# EAGLE board BMS (EAGLE 7.5.0), part 1 of 2 (continued)
## Placement (x,y rotation side) (continued)
R195  16  [RR02J16RTB]  6.88,34.42 0 top
R196  16  [RR02J16RTB]  3.45,30.23 180 top
R197  16  [RR02J16RTB]  7.14,43.43 0 top
R198  16  [RR02J16RTB]  3.07,38.61 180 top
R199  16  [RR02J16RTB]  3.33,47.62 180 top
R200  16  [RR02J16RTB]  6.38,52.71 0 top
R201  16  [RR02J16RTB]  6.25,61.47 0 top
R202  16  [RR02J16RTB]  2.69,57.02 180 top
R203  16  [RR02J16RTB]  5.87,69.09 0 top
R204  16  [RR02J16RTB]  2.57,65.41 180 top
R205  16  [RR02J16RTB]  5.99,76.96 0 top
R206  16  [RR02J16RTB]  2.18,73.02 180 top
R207  16  [RR02J16RTB]  6.12,84.84 0 top
R208  16  [RR02J16RTB]  2.31,80.64 180 top
R209  16  [RR02J16RTB]  6.12,92.15 0 top
R210  16  [RR02J16RTB]  2.57,88.57 180 top
R211  16  [RR02J16RTB]  2.44,97.61 180 top
R212  16  [RR02J16RTB]  6.25,101.14 0 top
R213  1K  [0603]  46.61,41.2 90 top
R214  10K  [MNR14]  44.38,31.27 90 top
R215  100K  [0603]  46.61,37.01 270 top
R216  1.2K  [0603]  52.4,58.81 180 top
R217  787  [0805]  47.25,57.06 90 top
R218  10K-NTC  [NTC-NXRT15XH103FA5B]  38,10.1 90 top
R219  10K-NTC  [NTC-NXRT15XH103FA5B]  27.77,36.08 90 top
R220  10K-NTC  [NTC-NXRT15XH103FA5B]  34.96,65.6 0 top
R221  10K-NTC  [NTC-NXRT15XH103FA5B]  27.17,91.56 270 top
SJ1  [PAD-JUMPER-3-NO_YES_SILK]  142.38,78.16 180 top
SJ2  [PAD-JUMPER-3-NO_YES_SILK]  142.38,76.13 180 top
SJ3  [PAD-JUMPER-3-NO_YES_SILK]  142.38,74.09 180 top
SJ4  [PAD-JUMPER-3-NO_YES_SILK]  142.38,72.06 180 top
SJ5  [PAD-JUMPER-2-NO_YES_SILK]  139.13,57.64 180 bottom
SJ6  [PAD-JUMPER-3-NO_YES_SILK]  97.75,72.46 180 top
SJ7  [PAD-JUMPER-3-NO_YES_SILK]  97.67,75.16 180 top
SJ8  [PAD-JUMPER-3-NO_YES_SILK]  97.7,77.8 180 top
SJ9  [PAD-JUMPER-3-NO_YES_SILK]  97.7,80.45 180 top
SJ10  [PAD-JUMPER-2-NO_YES_SILK]  102.55,55.36 90 top
SJ11  [PAD-JUMPER-3-NO_YES_SILK]  47.17,75.37 0 top
SJ12  [PAD-JUMPER-3-NO_YES_SILK]  47.11,78.09 0 top
SJ13  [PAD-JUMPER-3-NO_YES_SILK]  47.04,81.16 0 top
SJ14  [PAD-JUMPER-3-NO_YES_SILK]  46.98,84.24 0 top
SJ15  [PAD-JUMPER-2-NO_YES_SILK]  50.61,56.06 90 top
TX1  PE-68386NLT  [PE-68386NLT]  147.47,92.84 0 top
TX2  PE-68386NLT  [PE-68386NLT]  147.47,83.95 0 top
TX3  PE-68386NLT  [PE-68386NLT]  147.47,101.73 0 top
U1  LTC6804-2  [SSOP-48]  140.72,55.43 270 top
U2  LTC6804-2  [SSOP-48]  95.95,55.34 270 top
U3  LTC6804-2  [SSOP-48]  40.03,55.12 270 top
U$1  POGOPIN  [POGOPIN]  130.5,6.59 0 top
U$2  POGOPIN  [POGOPIN]  127.1,11.45 0 top
U$3  POGOPIN  [POGOPIN]  116.28,20.21 0 top
U$4  POGOPIN  [POGOPIN]  127.11,28.93 0 top
U$5  POGOPIN  [POGOPIN]  116.3,37.69 0 top
U$6  POGOPIN  [POGOPIN]  127.12,46.43 0 top
U$7  POGOPIN  [POGOPIN]  116.28,55.19 0 top
U$8  POGOPIN  [POGOPIN]  127.12,63.93 0 top
U$9  POGOPIN  [POGOPIN]  116.28,72.69 0 top
U$10  POGOPIN  [POGOPIN]  127.13,81.43 0 top
U$11  POGOPIN  [POGOPIN]  116.29,90.19 0 top
U$12  POGOPIN  [POGOPIN]  127.12,98.94 0 top
U$13  POGOPIN  [POGOPIN]  133.89,106.78 0 top
U$14  POGOPIN  [POGOPIN]  37.85,5.05 0 top
U$15  POGOPIN  [POGOPIN]  36.33,11.42 0 top
U$16  POGOPIN  [POGOPIN]  25.48,20.19 0 top
U$17  POGOPIN  [POGOPIN]  36.33,28.92 0 top
U$18  POGOPIN  [POGOPIN]  25.46,37.7 0 top
U$19  POGOPIN  [POGOPIN]  36.31,46.44 0 top
U$20  POGOPIN  [POGOPIN]  25.47,55.2 0 top
U$21  POGOPIN  [POGOPIN]  36.32,63.94 0 top
U$22  POGOPIN  [POGOPIN]  25.48,72.7 0 top
U$23  POGOPIN  [POGOPIN]  36.32,81.44 0 top
U$24  POGOPIN  [POGOPIN]  25.48,90.2 0 top
U$25  POGOPIN  [POGOPIN]  36.3,98.94 0 top
U$26  POGOPIN  [POGOPIN]  37.75,106.2 0 top
U$27  LOGO16-2-L  [2016-2-LOGO-L]  51.59,10.59 90 top
U$40  POGOPIN  [POGOPIN]  84.79,4.96 0 top
U$41  POGOPIN  [POGOPIN]  81.7,11.44 0 top
U$42  POGOPIN  [POGOPIN]  70.9,20.2 0 top
U$43  POGOPIN  [POGOPIN]  81.73,28.94 0 top
U$44  POGOPIN  [POGOPIN]  70.88,37.7 0 top
U$45  POGOPIN  [POGOPIN]  81.72,46.45 0 top
U$46  POGOPIN  [POGOPIN]  70.87,55.19 0 top
U$47  POGOPIN  [POGOPIN]  81.7,63.93 0 top
U$48  POGOPIN  [POGOPIN]  70.88,72.72 0 top
U$49  POGOPIN  [POGOPIN]  81.73,81.43 0 top
U$50  POGOPIN  [POGOPIN]  70.88,90.19 0 top
U$51  POGOPIN  [POGOPIN]  81.71,98.95 0 top
U$52  POGOPIN  [POGOPIN]  82.95,106.02 0 top

## Tracks (layer width: path | path; a pad name or v marks a point on that pad's centre or on a via)
A0  (via drill 0.5)
  Top 0.178: U2.45 95.71,59.59 95.25,60.05 v95.25,62.87 | v95.1,80.49 95.1,81.38 95.63,81.91 97.41,81.91 97.59,81.74 97.59,80.57 SJ9.2
  Bottom 0.178: v95.25,62.87 95.25,68.2 94.56,68.96 92.38,68.96 91.77,69.72 91.77,80.03 92.61,80.49 v95.1,80.49
A1  (via drill 0.5)
  Top 0.178: U2.46 96.84,60.09 96.52,60.4 v96.52,62.89 | v95.1,77.83 95.1,78.71 95.45,79.07 97.59,79.07 97.76,78.89 97.76,77.87 SJ8.2
  Bottom 0.178: v96.52,62.89 96.52,67.69 94.67,69.62 92.56,69.62 92.2,69.98 92.2,77.47 92.56,77.83 v95.1,77.83
A2  (via drill 0.5)
  Top 0.178: U2.47 97.94,60.59 97.76,60.76 v97.76,62.89 | v95.1,75.16 95.1,76.05 95.45,76.4 97.59,76.4 97.76,76.22 97.76,75.24 SJ7.2
  Bottom 0.178: v97.76,62.89 97.76,66.98 94.84,70.05 93.12,70.05 92.79,70.38 92.79,74.8 93.14,75.16 v95.1,75.16
A3  (via drill 0.5)
  Top 0.178: U2.48 99.37,62.53 v99.01,62.89 | v95.1,72.49 95.1,73.38 95.45,73.74 97.41,73.74 97.76,73.38 97.76,72.47 SJ6.2
  Bottom 0.178: v99.01,62.89 99.01,66.42 95.17,70.48 93.65,70.48 93.45,70.69 93.45,72.31 93.62,72.49 v95.1,72.49
A4
  Top 0.178: SJ4.2 142.38,71.18 143.18,70.38 143.18,63.3 141.81,61.93 141.81,60.33 142.42,59.72 143.87,59.72 143.94,59.64 144.1,59.64 U1.45
A5
  Top 0.178: SJ3.2 142.38,74.92 142.57,75.11 144.12,75.11 144.27,74.95 144.27,63.63 142.34,61.7 142.34,60.63 142.8,60.17 U1.46
A6
  Top 0.178: SJ2.2 142.38,76.92 142.57,77.11 144.48,77.11 144.68,76.89 144.68,63.37 144.37,63.07 144.35,63.07 142.82,61.54 142.82,60.91 143.03,60.71 144.12,60.71 U1.47
A7
  Top 0.178: U1.48 144.14,62.07 145.08,63.02 145.08,79.05 144.35,79.78 142.75,79.78 142.39,79.43 142.39,78.21 SJ1.2
A8  (via drill 0.5)
  Top 0.178: U3.45 50.33,59.37 52.15,61.06 55.35,61.06 55.98,61.72 55.98,66.09 v55.63,66.45 | v51.18,84.23 51.18,85.83 50.65,86.36 47.27,86.36 46.91,86 46.91,84.3 SJ14.2
  Bottom 0.178: v51.18,84.23 55.35,84.23 55.58,84 55.58,66.5 v55.63,66.45
A9  (via drill 0.5)
  Top 0.178: U3.46 50.29,59.87 51.89,61.44 53.37,61.44 53.72,61.82 53.82,65.02 53.29,65.56 52.6,65.56 52.43,65.73 v52.43,66.45 | v51.18,81.2 51.18,82.27 50.83,82.63 47.27,82.63 46.91,82.27 46.91,81.29 SJ13.2
  Bottom 0.178: v52.43,66.45 52.43,67.16 52.78,67.51 52.78,75.36 51.89,76.25 51.71,76.4 51,77.11 51,81.03 v51.18,81.2
A10  (via drill 0.5)
  Top 0.178: U3.47 49.9,60.37 51.16,61.67 51.16,67 51.54,67.33 53.85,67.33 54.03,67.16 v54.03,66.45 | v52.07,78.16 52.07,79.07 51.54,79.6 47.63,79.6 47.09,79.07 47.09,78.1 SJ12.2
  Bottom 0.178: v54.03,66.45 54.2,66.45 54.18,69.62 54.2,77.49 53.49,78.21 52.1,78.18 v52.07,78.16
A11
  Top 0.178: U3.48 49.68,60.87 50.77,61.88 50.77,71.65 50.11,72.31 47.8,72.31 47.27,72.85 47.27,75.27 SJ11.2
C0  (via drill 0.5)
  Top 0.178: v82.3,17.91 84.01,17.91 R110.2 | U2.26 v101.85,50.09
  Bottom 0.178: v82.3,17.91 82.3,18.26 81.94,18.62 79.45,18.62 79.1,18.97 79.1,23.06 78.96,23.2 C57.1 77.95,23.28 C55.2 84.06,25.39 84.61,24.84 84.61,23.06 85.32,22.35 89.94,22.35 90.3,22.71 90.3,48.57 90.75,49.02 101.68,49.02 102.03,49.38 102.03,49.91 v101.85,50.09
C1  (via drill 0.5)
  Top 0.178: R107.2 v85.5,23.77 87.99,23.77 88.34,24.13 88.34,49.38 88.55,49.59 U2.24
  Bottom 0.178: C56.1 77.85,26.99 C55.1 77.95,30.35 | 77.95,30.35 77.95,30.63 78.56,31.24 78.56,32.32 C53.2 | v85.5,23.77 85.5,30.17 85.14,30.53 78.13,30.53 77.95,30.35
C2  (via drill 0.5)
  Top 0.178: R104.2 v85.14,31.6 86.97,31.6 87.5,32.13 87.5,50.08 88.01,50.59 U2.22
  Bottom 0.178: C51.2 C53.1 | C54.1 78.41,34.18 C53.1 | C53.1 84.6,34.1 85.14,33.55 v85.14,31.6
C3  (via drill 0.5)
  Top 0.178: R101.2 v85.14,37.29 86.21,37.29 86.64,37.72 86.64,50.9 87.33,51.59 U2.20
  Bottom 0.178: C49.2 C51.1 | C52.1 78.41,38.09 C51.1 | C51.1 80,38.01 80.34,38.35 84.79,38.35 85.14,38 v85.14,37.29
C4  (via drill 0.5)
  Top 0.178: U2.18 86.16,52.59 85.75,52.17 85.75,48.67 85.32,48.23 v85.32,43.16 83.55,43.16 R98.2
  Bottom 0.178: C47.2 C49.1 | C50.1 78.41,42.36 C49.1 | C49.1 79.82,42.28 80.16,42.62 80.16,44.4 80.52,44.76 85.14,44.76 85.32,44.58 v85.32,43.16
C5  (via drill 0.5)
  Top 0.178: R92.2 82.71,51.16 v84.43,51.16 84.43,53.29 84.73,53.59 U2.16
  Bottom 0.178: C48.1 78.41,46.16 C47.1 C43.2 79.62,48.66 79.81,48.84 79.81,51.87 79.98,52.05 84.25,52.05 84.43,51.87 v84.43,51.16
C6  (via drill 0.5)
  Top 0.178: U2.14 92.48,54.53 84.28,54.53 83.95,54.94 v83.95,56.31 83.92,56.34 R95.2
  Bottom 0.178: C44.1 78.41,50.43 C43.1 78.31,50.53 C45.2 78.4,58.62 79.27,58.62 79.63,58.27 79.63,57.91 79.98,57.56 83.67,57.56 83.95,57.28 v83.95,56.31
C7  (via drill 0.5)
  Top 0.178: U2.12 85.87,55.59 85.5,55.96 85.5,60.94 85.14,61.29 v84.25,61.29 82.49,61.29 82.49,60.63 R89.2
  Bottom 0.178: C41.2 C45.1 | C46.1 78.28,60.39 C45.1 | C45.1 79.44,60.41 79.98,59.87 83.9,59.87 84.25,60.22 v84.25,61.29
C8  (via drill 0.5)
  Top 0.178: R86.2 v84.25,70.54 85.9,70.54 86.36,70 86.36,57 86.7,56.59 U2.10
  Bottom 0.178: C42.1 78.23,64.3 C41.1 C39.2 79.21,66.33 79.45,66.09 81.23,66.09 81.41,65.91 82.22,65.91 82.83,65.23 83.9,65.23 84.43,65.91 84.43,70.36 v84.25,70.54
C9  (via drill 0.5)
  Top 0.178: R83.2 84.23,75.84 v84.25,75.87 | v83.19,66.09 83.19,63.6 83.54,63.25 v84.07,63.25 | v87.63,58.09 88.16,57.56 92.5,57.56 U2.8
  Bottom 0.178: C40.1 78.13,68.21 C39.1 | C39.1 78.21,68.13 78.21,69.11 77.6,69.72 C37.2 77.81,76.58 78.92,76.58 79.45,77.11 83.9,77.11 84.25,76.76 v84.25,75.87 | C39.1 82.84,68.03 83.19,67.69 v83.19,66.09 | v84.07,63.25 86.92,63.25 87.45,62.71 87.45,58.27 v87.63,58.09
C10  (via drill 0.5)
  Top 0.178: R77.2 83.07,85.29 v84.79,85.29 87.05,85.29 87.66,84.68 87.66,60.22 89.07,58.59 U2.6
  Bottom 0.178: C38.1 77.49,78.6 C37.1 C34.2 80.33,80.86 81.05,80.14 84.61,80.14 85.14,80.67 85.14,84.94 v84.79,85.29
C11  (via drill 0.5)
  Top 0.178: R78.2 v84.79,90.63 87.63,90.63 88.49,89.84 88.49,60.5 89.34,59.59 U2.4
  Bottom 0.178: C36.1 77.49,82.66 C34.1 C33.2 83.17,84.93 84.79,86.54 v84.79,90.63
C12  (via drill 0.5)
  Top 0.178: v84.96,95.61 R76.2 | U2.2 89.76,60.59 89.41,60.94 v89.41,93.47
  Bottom 0.178: 74.61,86.89 C35.1 77.24,86.98 C33.1 | C33.1 77.6,96.77 78.21,97.38 84.43,97.38 84.96,96.85 v84.96,95.61 | C33.1 83.1,86.63 83.72,87.25 83.72,91.16 84.25,91.69 89.05,91.69 89.41,92.05 v89.41,93.47
C13  (via drill 0.5)
  Top 0.178: v126.57,89.56 129.95,89.56 130.3,89.92 130.3,91.15 R4.2 130.29,91.16 135.79,91.16 136.68,90.27 136.68,62.23 136.25,61.8 136.25,60.78 136.35,60.68 U1.2
  Bottom 0.178: C5.1 123.96,88.79 124.26,88.49 | 124.26,88.49 124.26,86.52 C3.1 | 124.26,88.49 126.21,88.49 126.57,88.85 v126.57,89.56
C14  (via drill 0.5)
  Top 0.178: R6.2 130.09,86 v131.9,86 134.21,86 135.43,84.94 135.43,60.2 135.95,59.68 U1.4
  Bottom 0.178: C6.1 124.36,84.72 C3.2 | C3.2 124.38,79.84 C4.1 | C3.2 131.48,84.7 131.9,85.11 v131.9,86
C15  (via drill 0.5)
  Top 0.178: R11.2 129.91,74.09 v131.72,74.09 132.79,74.09 133.71,73.33 133.63,58.22 134.17,57.68 U1.8
  Bottom 0.178: C10.1 124.71,74.1 C7.2 | C7.2 124.74,71.26 C9.1 | C7.2 126.22,74.08 126.57,73.74 126.57,73.02 126.92,72.67 131.55,72.67 131.72,72.85 v131.72,74.09
C16  (via drill 0.5)
  Top 0.178: U1.12 132.1,55.68 131.83,56.03 131.83,61.37 131.37,61.82 | v126.92,60.94 127.46,60.4 131.01,60.4 131.37,60.76 131.37,61.82 | 131.37,61.82 131.37,64.17 R17.2
  Bottom 0.178: C16.1 122.15,56.12 C15.1 C11.2 125.49,58.45 126.57,58.45 126.92,58.8 v126.92,60.94
C17  (via drill 0.5)
  Top 0.178: U1.14 131.42,54.68 130.96,55.14 130.96,56.29 130.76,56.49 130.06,56.49 R23.2 129.95,56.43 129.95,55.42 129.59,55.07 v127.1,55.07
  Bottom 0.178: C14.1 122.17,52.41 C13.1 C15.2 126.45,54.42 v127.1,55.07
C18  (via drill 0.5)
  Top 0.178: U1.16 131.46,53.68 131.01,53.32 131.01,52.22 130.84,52.05 130.3,52.05 130.12,51.87 129.81,51.87 R20.2 130.99,51.38 v131.17,51.21
  Bottom 0.178: C18.1 124.36,48.6 C17.1 124.79,48.27 124.79,49.38 125.45,50.04 C13.2 126.66,50.71 127.1,50.27 127.1,49.73 127.28,49.55 130.91,49.55 131.17,49.81 v131.17,51.21
C19  (via drill 0.5)
  Top 0.178: R29.2 130.09,38.53 v131.72,38.53 132.87,38.53 133.27,38.94 133.27,51.33 133.62,51.68 U1.20
  Bottom 0.178: C19.2 C23.1 | C24.1 125.19,39.77 C23.1 | C23.1 131.46,39.51 131.72,39.24 v131.72,38.53
C20  (via drill 0.5)
  Top 0.178: R32.2 130.09,32.84 v131.72,32.84 133.86,32.84 134.29,33.27 134.29,50.37 134.6,50.68 U1.22
  Bottom 0.178: C25.1 C23.2 | C26.1 125.37,35.8 C25.1 | C25.1 126.53,35.72 126.92,35.33 126.92,34.44 127.28,34.09 131.37,34.09 131.72,33.73 v131.72,32.84
C21  (via drill 0.5)
  Top 0.178: v130.66,28.4 130.66,26.91 R35.2 134.21,26.8 135.15,27.51 135.15,49.38 135.46,49.68 U1.24
  Bottom 0.178: C27.1 125.39,25.02 123.01,25.02 122.25,25.78 C28.1 122.29,32.13 125.15,32.13 125.45,32.44 C25.2 125.45,27.74 126.03,27.15 127.46,27.15 128.52,28.22 130.48,28.22 v130.66,28.4
C22  (via drill 0.5)
  Top 0.178: R5.2 129.96,79.07 v131.55,79.07 133.68,79.07 134.57,78.18 134.57,59.05 134.94,58.68 U1.6
  Bottom 0.178: C8.1 124.71,77.81 C4.2 | C4.2 C7.1 | C4.2 131.33,77.79 131.55,78 v131.55,79.07
C23  (via drill 0.5)
  Top 0.178: U1.26 145.15,50.18 145.24,50.09 145.24,49.02 143.28,47.07 v142.21,47.07 | v132.61,20.75 130.64,20.75 R38.2
  Bottom 0.178: C27.2 C29.1 131.99,21.37 v132.61,20.75 133.32,21.46 133.32,23.06 134.92,24.66 138.3,24.66 140.61,26.97 140.61,46.71 140.97,47.07 v142.21,47.07
C24  (via drill 0.5)
  Top 0.178: v127.28,42.8 129.77,42.8 129.95,42.98 129.95,44.23 R26.2 130.14,44.22 132.05,44.22 132.41,44.65 132.41,52.27 132.89,52.68 U1.18
  Bottom 0.178: C22.1 124.61,46.39 C17.2 124.74,45.34 125.32,44.76 125.32,43.55 C19.1 126.66,43.42 v127.28,42.8
C25  (via drill 0.5)
  Top 0.178: R14.2 129.86,69.29 131.55,69.29 131.72,69.11 v131.72,68.4 132.77,67.51 132.77,57.02 133.11,56.68 U1.10
  Bottom 0.178: C12.1 124.51,69.33 C9.2 | C9.2 124.59,62.38 125.32,61.65 125.32,60.31 C11.1 | C9.2 125.92,69.41 126.39,68.94 126.39,68.4 126.75,68.05 131.37,68.05 v131.72,68.4
C26  (via drill 0.5)
  Top 0.178: v21.13,94.72 21.23,94.82 R151.2 23.8,94.7 23.8,94 23.98,93.83 30.89,93.83 31.6,93.12 31.52,60.94 32.09,60.37 U3.2
  Bottom 0.178: C67.1 21.23,85.25 C65.1 21.13,85.36 v21.13,94.72
C27  (via drill 0.5)
  Top 0.178: R153.2 25.63,85.47 v27.36,85.47 30.25,85.47 30.68,85.11 30.68,60.22 31.39,59.37 U3.4
  Bottom 0.178: C68.1 21.29,80.63 C66.1 21.36,83.43 | 21.36,83.43 C65.2 | 21.36,83.43 22.29,83.43 22.73,83.87 22.73,84.23 23.09,84.58 27,84.58 27.36,84.94 v27.36,85.47
C28  (via drill 0.5)
  Top 0.178: R158.2 25.49,75.34 v27.18,75.34 28.19,75.34 28.96,74.57 28.96,58.65 30.24,57.37 U3.8
  Bottom 0.178: C72.1 21.23,67.17 C71.1 21.49,67.3 C69.2 26.81,74.61 27.18,74.98 v27.18,75.34
C29  (via drill 0.5)
  Top 0.178: v26.77,59.87 25.46,59.87 R164.2 | U3.12 27.74,55.37 27.2,55.91 27.2,59.44 v26.77,59.87 | 27.18,59.69 v26.77,59.87
  Bottom 0.178: C78.1 C77.1 21.23,58.41 C73.2 26.61,61.28 26.77,61.04 v26.77,59.87
C30  (via drill 0.5)
  Top 0.178: R170.2 v25.76,52.4 26.34,52.4 26.52,52.65 26.52,54 26.81,54.37 U3.14
  Bottom 0.178: C76.1 C75.1 | C75.1 C77.2 | C75.1 22.19,49.9 22.38,50.09 22.38,50.98 22.73,51.33 25.58,51.33 25.76,51.51 v25.76,52.4
C31  (via drill 0.5)
  Top 0.178: U3.16 36.58,53.34 27.61,53.34 27.38,53.11 27.38,49.2 27.2,49.02 v26.82,49.02 26.82,48.49 26.64,48.31 25.46,48.31 R167.2
  Bottom 0.178: C80.1 C79.1 C75.2 22.09,48.2 22.56,48.67 22.56,49.02 22.91,49.38 26.47,49.38 v26.82,49.02
C32  (via drill 0.5)
  Top 0.178: U3.20 29.57,51.37 29.18,50.9 29.18,33.83 28.6,33.55 v27.89,33.55 27.89,34.62 27.71,34.8 R176.2
  Bottom 0.178: C84.1 C83.1 | C83.1 20.98,39.18 C81.2 | C83.1 22.16,32.62 22.56,33.02 22.56,33.55 22.73,33.73 27.71,33.73 v27.89,33.55
C33  (via drill 0.5)
  Top 0.178: R179.2 25.54,30 v27.36,30 29.54,30 30.05,30.28 30.05,49.84 30.58,50.37 U3.22
  Bottom 0.178: C86.1 C85.1 C83.2 27.14,30.92 27.36,30.71 v27.36,30
C34  (via drill 0.5)
  Top 0.178: 25.64,24.89 R182.2 v27.18,25.02 30.18,25.02 30.94,25.48 30.94,48.77 31.46,49.37 U3.24
  Bottom 0.178: C88.1 C87.1 18.62,24.82 19,25.2 19.53,25.2 19.71,25.38 19.71,25.91 19.89,26.09 21.09,26.09 C85.2 26.81,26.1 27.18,25.73 v27.18,25.02
C35  (via drill 0.5)
  Top 0.178: R152.2 25.46,80.85 v27.18,80.85 29.31,80.85 29.82,80.34 29.82,59.72 30.94,58.37 U3.6
  Bottom 0.178: C70.1 C69.1 C66.2 22.34,78.85 22.91,79.43 26.82,79.43 27.18,79.78 v27.18,80.85
C36  (via drill 0.5)
  Top 0.178: R185.2 33.38,19.04 C89.1 | R185.2 28.72,19.04 v28.6,19.15 | U3.26 44.29,49.87 44.78,49.38 44.78,49.02 44.42,48.67 38.56,48.67 38.02,48.13 32.16,48.13 31.85,47.83 31.85,19.77 R185.2
  Bottom 0.178: v28.6,19.15 26.47,19.15 26.11,18.8 23.98,18.8 23.62,19.15 23.62,21.29 23.27,21.64 18.76,21.64 C87.2
C37  (via drill 0.5)
  Top 0.178: R173.2 25.59,42.98 v27.36,42.98 27.97,42.98 28.32,43.33 28.32,52.05 28.64,52.37 U3.18
  Bottom 0.178: C82.1 C81.1 21.11,41.26 C79.2 26.91,44.13 27.36,43.69 v27.36,42.98
C38  (via drill 0.5)
  Top 0.178: R161.2 25.24,67.33 v26.82,67.33 27.81,67.33 28.09,67.06 28.09,56.64 28.37,56.37 U3.10
  Bottom 0.178: C74.1 21.11,62.85 C73.1 21.36,63.11 C71.2 26.56,65.47 26.82,65.73 v26.82,67.33
DRIVE  (via drill 0.5)
  Top 0.178: U2.38 97.81,56.09 v97.41,56.49 | v104.14,63.27 102.33,63.27 1.B
  Bottom 0.178: v97.41,56.49 97.41,57.02 97.59,57.2 104.34,57.2 104.7,57.56 104.7,63.25 v104.14,63.27
DRIVE1  (via drill 0.3)
  Top 0.178: U1.38 141.99,56.18 140.89,57.28 v140.67,57.28
  Bottom 0.178: v140.67,57.28 140.67,65.66 141.73,66.73 2.B
DRIVE2
  Top 0.178: U3.38 40.78,55.87 40.34,56.31 40.34,59.16 40.51,59.33 40.69,59.33 40.87,59.51 40.87,60.4 42.11,61.65 42.65,61.65 43.54,62.54 46.25,62.54 46.94,62.92 46.94,66.61 3.B 46.89,66.86
GND  (via drill 0.5)
  Top 0.178: U3.30 v46.56,51.87 | C90.2 52.33,54.04 52.4,53.98
  other vias: 19.89,37.29 43.84,43.31 45.95,64.52 50.44,73.79 52.4,62.33 39.55,50.44 34.26,46.89 45.64,57.45 36.91,62.13 41.48,54.71 35.48,71.37 41.78,71.07 51.05,46.36 49.94,70.74
  pour Bottom: 0.15,0.13 0.15,111.38 53.14,112.37 53.29,-0.71
  pour Top (rank 6): 0.15,0.13 53.29,-0.51 53.06,111.35 0.15,111.38
GNDA  (via drill 0.5)
  Top 0.178: R144.P$1 80.21,62.65 78.94,61.47 74.83,61.47 v73.94,62.36 | U2.31 v97.24,52.59 v97.23,52.58
  other vias: 99.72,42.04 96.52,55.55 104.34,68.02 96.67,70.89 93.9,62.81
  pour Bottom: 59.84,114.43 105.56,114.43 105.56,-3.68 59.84,-3.68
  pour Top: 59.84,111.89 105.56,111.89 105.56,-1.14 59.84,-1.14
GNDI  (via drill 0.5, 0.6)
  Top 0.178: U1.31 142.11,52.68
  other vias: 133.76,18.41 127.41,18.41 136.8,44.58 126.64,94.36 138.3,73.56 141.15,52.76 134.92,89.92 139.6,79.68 132.13,93.5 141.99,33.6 133.25,87.3 138.18,27.25 128.45,61.39 130.48,63.17
  pour Top: 111.91,111.89 145.24,111.71 144.93,-1.14 111.91,-1.14
  pour Bottom: 111.91,114.43 144.93,114.43 144.93,-3.68 111.91,-3.68
GPIO1  (via drill 0.5)
  Top 0.178: U2.27 98.08,50.59 97.59,50.09 97.59,46 | 97.59,46 97.59,41.2 97.41,41.02 97.05,41.02 96.88,40.84 96.88,36.75 96.52,36.4 95.71,36.4 95.57,36.26 R139.1 | R143.P$2 68.93,94.51 69.49,95.07 75.72,95.07 76.07,95.43 76.07,100.05 77.14,101.12 81.23,101.12 81.58,101.47 81.58,102.72 82.12,103.25 83.36,103.25 83.72,102.89 83.72,102.36 84.07,102.01 90.12,102.01 90.83,101.3 90.83,89.2 90.65,88.67 90.65,69.65 91.19,69.11 104.88,69.11 105.59,68.58 105.59,46 v104.7,45.29 | v98.83,45.29 98.3,45.29 97.59,46
  Bottom 0.178: v104.7,45.29 v98.83,45.29
GPIO2  (via drill 0.5)
  Top 0.178: U2.28 96.81,51.09 96.52,50.8 v96.52,50.27 96.52,49.2 97.05,48.67 97.05,41.73 96.7,41.38 95.81,41.38 95.45,41.02 95.45,36.75 94.56,35.87 94.56,34.68 R139.2
  Bottom 0.178: R144.P$2 82.27,65.18 82.6,64.85 89.94,64.85 90.3,64.49 90.3,50.98 91.01,50.27 v96.52,50.27
GPIO3  (via drill 0.5)
  Top 0.178: R145.P$2 77.99,36.18 78.56,36.75 78.56,37.47 79.1,38 80.16,38 81.05,38.89 84.96,38.89 85.32,39.24 v85.32,39.6 | v89.41,39.6 93.32,39.6 | 93.32,39.6 93.5,39.6 94.03,39.07 94.03,34.71 R139.3 | 93.32,39.6 95.28,41.55 95.28,51.16 95.7,51.59 U2.29
  Bottom 0.178: v85.32,39.6 v89.41,39.6
GPIO4  (via drill 0.5)
  Top 0.178: U2.32 98.32,53.09 97.94,53.47 94.74,53.47 94.39,53.11 v94.39,42.09 | R139.4 93.07,35.98 92.89,36.17 92.3,36.17 v92.25,36.22
  Bottom 0.178: R146.P$2 83.46,12.75 90.65,12.75 91.36,13.46 91.36,35.69 91.9,36.22 v92.25,36.22 92.25,41.2 92.61,41.55 94.03,41.55 94.39,41.91 v94.39,42.09
GPIO5
  Top 0.178: R138.2 101.12,34.34 101.12,38.71 101.47,39.07 102.74,39.07 103.1,39.42 103.1,50.98 102.74,51.33 100.79,51.33 100.61,51.51 100.61,53.47 100.43,53.65 99.43,53.65 U2.33
GPIO6  (via drill 0.3)
  Top 0.178: R67.2 140.57,50.23 140.79,50.44 | 140.79,50.44 141.5,51.16 144.12,51.16 U1.28 | v140.61,50.8 140.79,50.44
  Bottom 0.178: v140.61,50.8 134.57,50.8 134.04,51.33 134.04,61.47 133.68,62 129.13,62 R72.P$2
GPIO7  (via drill 0.3, 0.5)
  Top 0.178: U1.27 142.21,50.68 | 142.21,50.68 141.92,50.68 141.33,50.09 141.33,38.13 R67.1 | R71.P$2 117.71,93.8 v117.68,93.83 | v142.21,50.16 142.21,50.68
  Bottom 0.178: v117.68,93.83 124.97,93.83 125.32,94.18 125.32,99.69 125.86,100.23 129.24,100.23 129.59,99.87 129.59,95.55 130.45,94.69 134.8,94.69 136.04,93.45 137.06,92.41 137.06,52.05 137.41,51.87 140.97,51.87 141.5,51.33 141.5,50.44 141.86,50.16 v142.21,50.16
GPIO8
  Top 0.178: R147.P$2 128.8,14.45 129.24,14.88 134.92,14.88 135.81,15.77 135.81,37.29 136.53,38 138.89,38 R67.4 139.07,38.03 139.07,39.95 139.08,52.28 140.41,53.62 141.63,53.62 142.07,53.18 U1.32
GPIO9  (via drill 0.5)
  Top 0.178: 139.75,38.06 R67.3 | U1.29 140.25,51.68 139.73,51.16 139.73,38.08 R67.3 | v137.39,36.37 137.59,36.4 138.3,37.11 139.55,37.11 139.73,37.29 139.73,37.98 R67.3
  Bottom 0.178: R73.P$2 120.54,39.4 121.21,38.66 130.28,38.66 130.84,38.18 130.84,37.47 131.19,37.11 136.7,37.11 v137.39,36.37
GPIO10
  Top 0.178: U1.33 145.1,53.68 145.31,53.47 145.31,50.62 145.62,50.32 145.62,48.74 143.08,46.2 143.08,30.61 142.06,29.59 142.06,29.09 R66.2
GPIO11  (via drill 0.5)
  Top 0.178: U3.28 45.6,50.87 46.74,49.73 46.74,47.42 46.56,47.24 41.05,47.24 40.51,46.71 40.51,31.6 40.34,31.42 40.16,31.42 39.8,31.06 v39.8,30.71 | v48.34,28.75 47.63,28.75 46.91,29.46 46.91,30.53 46.56,30.89 R214.2
  Bottom 0.178: v48.34,28.75 48.16,28.75 46.74,27.25 40.16,27.25 39.8,27.69 v39.8,30.71 39.8,38.18 39.4,38.58 R219.P$2
GPIO12  (via drill 0.5)
  Top 0.178: v38.2,30.71 38.2,31.6 38.56,31.95 39.62,31.95 39.98,32.31 39.98,47.24 40.51,47.78 45.67,47.78 46.02,48.13 46.02,49.55 45.14,50.44 43.53,50.44 U3.27 | v48.34,26.97 46.38,28.93 46.38,29.82 46.2,30 45.3,30 R214.1
  Bottom 0.178: v38.2,30.71 38.2,27.33 38.74,26.8 39.09,26.8 | 39.09,26.8 48.16,26.8 v48.34,26.97 | R218.P$2 38.76,12.6 39.09,12.93 39.09,26.8
GPIO13  (via drill 0.5)
  Top 0.178: v42.65,29.11 42.65,30 42.29,30.35 41.94,30.35 41.58,30.71 41.58,45.82 41.94,46.18 47.45,46.18 47.8,46.53 47.8,52.4 47.34,52.87 U3.32 43.39,52.93 41.76,52.93 41.4,53.29 v39.8,53.29 | v48.34,32.31 47.8,32.31 47.59,32.52 R214.4 | v34.65,89.2 v38.02,89.2
  Bottom 0.178: v42.65,29.11 42.65,28.57 43,28.22 45.85,28.22 46.38,28.75 46.38,31.95 46.74,32.31 v48.34,32.31 | R221.P$2 34.5,89.06 v34.65,89.2 | v38.02,89.2 38.02,69.65 38.38,69.29 39.27,69.29 39.62,68.94 39.62,53.47 v39.8,53.29
GPIO14  (via drill 0.5)
  Top 0.178: v41.05,29.11 41.05,46.36 41.4,46.71 47.09,46.71 47.27,46.89 47.27,49.91 45.81,51.37 U3.29 43.42,51.33 38.74,51.33 38.38,51.69 38.38,64.67 37.46,65.59 R220.P$2 | v48.34,30.53 48.34,30.89 47.63,31.6 45.35,31.6 R214.3
  Bottom 0.178: v41.05,29.11 41.05,28.04 41.4,27.69 46.36,27.69 46.81,28.22 46.81,30.25 47.09,30.53 v48.34,30.53
GPIO15
  Top 0.178: U3.33 47.44,53.37 48.41,52.35 48.41,44.12 47.63,43.16 46.91,43.16 46.56,42.8 46.56,42.1 R213.2 46.74,42.18
IBIAS  (via drill 0.5)
  Top 0.178: U2.44 100.54,59.09 v101.14,59.69
  Bottom 0.178: R141.2 100.85,60.34 101.14,60.05 v101.14,59.69
IBIAS1
  Top 0.178: R69.2 141.83,63.93 141.43,63.53 141.43,59.79 142.04,59.18 U1.44
IBIAS2
  Top 0.178: U3.44 51.49,58.87 R216.2
ICMP  (via drill 0.5)
  Top 0.178: v101.14,58.09 101.14,58.45 100.97,58.62 99.41,58.62 U2.43
  Bottom 0.178: R142.2 96.29,58.55 R141.1 97.04,58.64 97.59,58.09 v101.14,58.09
ICMP1
  Top 0.178: R70.2 140.11,65.23 R69.1 140.13,63.99 140.67,63.45 140.67,59.72 141.73,58.67 144.17,58.67 U1.43
ICMP2
  Top 0.178: R216.1 53.25,58.21 52.78,57.73 51,57.73 50.37,58.37 47.8,58.37 | U3.43 47.8,58.37 | 47.4,57.84 47.8,57.84 47.8,58.37
  Top 0.254: R217.2 47.4,57.96 47.4,57.84
IMA  (via drill 0.5)
  Top 0.178: U2.41 99.35,57.56 95.63,57.56 95.45,57.38 v95.45,56.67 | v138.13,94 138.13,90.63 138.48,90.27 144.07,90.27 TX1.3
  Bottom 0.178: v95.45,56.67 95.1,57.02 94.92,57.02 94.56,57.38 93.14,57.38 92.79,57.73 92.79,67.87 91.36,69.29 91.36,80.67 92.25,81.56 92.25,93.65 94.21,95.61 105,95.61 105.46,95.99 119.96,95.99 125.15,101.12 129.95,101.12 130.35,101.52 135.59,101.52 136.09,101.02 136.09,94.59 136.65,94.03 138.1,94.03 v138.13,94
IMA1  (via drill 0.3)
  Top 0.178: U1.41 142.97,57.68 v142.57,57.28 | TX2.3 143.97,81.28 v142.57,81.28 141.93,81.92 R148.2
  Bottom 0.178: v142.57,57.28 142.57,57.35 143.1,57.89 144.4,57.89 144.55,58.04 144.55,80.67 144.4,80.82 143.03,80.82 v142.57,81.28
IMA2  (via drill 0.5)
  Top 0.178: TX3.3 141.78,99.19 | 141.78,99.19 137.57,99.19 137.06,99.69 137.06,102.54 136.7,102.89 v133.68,102.89 | v41.4,57.2 42.16,57.2 42.47,57.38 43.44,57.38 U3.41 | R1.2 141.83,100.94 141.83,100.89 141.78,100.89 141.78,99.19
  Bottom 0.178: v133.68,102.89 124.97,102.89 124.79,102.72 118.57,96.85 90.65,96.85 90.12,97.38 90.12,100.05 89.59,100.58 76.96,100.58 76.61,100.23 76.61,96.14 76.25,95.78 44.07,95.78 43.89,95.61 43.89,62.71 43.18,62 43.18,57.73 42.65,57.2 v41.4,57.2
IPA  (via drill 0.5)
  Top 0.178: U2.42 98.3,58.09 97.76,58.62 94.39,58.62 94.21,58.45 v94.21,55.96 | v137.24,95.43 144.04,95.43 TX1.1
  Bottom 0.178: v137.24,95.43 136.53,96.14 136.53,101.65 136.17,102.01 125.15,102.01 119.63,96.42 105.23,96.42 104.88,96.14 93.68,96.14 91.72,94.18 91.72,81.91 90.83,81.03 90.83,69.11 92.25,67.69 92.25,56.13 92.79,55.96 v94.21,55.96
IPA1  (via drill 0.3)
  Top 0.178: U1.42 141.95,58.18 v141.73,57.96 | TX2.1 144.04,86.54 v142.34,86.54 141.93,86.13 R148.1
  Bottom 0.178: v141.73,57.96 142.04,58.27 142.72,58.27 142.88,58.42 143.94,58.42 144.09,58.57 144.09,79.91 143.79,80.21 142.04,80.21 141.66,80.59 141.66,85.85 v142.34,86.54
IPA2  (via drill 0.5)
  Top 0.178: TX3.1 141.76,104.27 | 141.76,104.27 133.91,104.27 v133.68,104.5 | v41.43,58.42 42.11,57.89 43.41,57.89 U3.42 | R1.1 141.76,102.64 141.76,104.27
  Bottom 0.178: v133.68,104.5 124.61,104.5 117.68,97.56 91.9,97.56 91.01,98.45 91.01,100.58 90.3,101.3 76.25,101.3 75.9,100.94 75.9,96.85 75.72,96.67 43.89,96.67 43.36,96.14 43.36,63.6 42.82,63.07 41.58,63.07 41.22,62.71 41.22,58.62 v41.43,58.42
N$1
  Top 0.178: Q12.1 122.9,88.07 123.19,87.78 128.17,87.78 128.35,87.96 128.35,88.56 R7.1
N$2  (via drill 0.5)
  Top 0.178: 124.79,88.8 Q12.2
  Top 0.406: R64.P$2 111.15,94.87 R65.P$2 | D1.A 119.79,89.71 119.99,89.92 | 119.99,89.92 124.43,89.92 124.79,89.56 124.79,88.8 | 119.99,89.92 119.46,90.45 119.46,94.72 119.3,94.87 116.61,94.87 v116.51,94.77
  Bottom 0.406: v116.51,94.77 111.51,94.77 R64.P$2
N$3
  Top 0.178: 119.74,86.75 D1.C
  Top 0.406: R9.2 119.74,86.75
N$4
  Top 0.178: 123.83,85.83 Q11.3 | 117.46,84.94 R9.1 | 111.65,91.52 R65.P$1
  Top 0.406: Q11.3 128.14,85.81 R6.1 | 123.83,85.83 120.7,85.83 120.52,85.65 119.63,85.65 119.28,85.29 117.82,85.29 R9.1 | 117.46,84.94 116.26,84.94 116.08,85.11 116.08,88.49 115.01,89.56 114.12,89.56 113.59,90.09 113.59,90.63 | 113.59,90.63 113.59,90.98 113.06,91.52 111.65,91.52 | F26.2 114.83,91.87 113.59,90.63
  Bottom 0.406: R64.P$1 108.3,94.87 R65.P$1
N$5
  Top 0.178: Q11.1 122.9,82.92 123.19,82.63 125.68,82.63 126.03,82.98 126.03,83.69 126.21,83.87 128.23,83.87 R8.1
N$6
  Top 0.178: 119.81,83.75 D2.A | 111.71,87.96 R62.P$2
  Top 0.406: R62.P$2 111.4,88.01 R63.P$2 | Q11.2 124.8,84.39 124.43,84.76 119.99,84.76 119.81,84.58 | 119.81,84.58 119.81,83.75 | 119.81,84.58 118.92,84.58 118.75,84.4 118.75,83.69 118.57,83.52 115.82,83.52 115.39,83.87 115.39,87.6 115.04,87.96 111.71,87.96
N$7
  Top 0.178: 119.66,81.75 D2.C
  Top 0.406: R10.2 119.66,81.75
N$8
  Top 0.178: 123.55,79 Q10.3 127.99,78.95 R5.1
  Top 0.406: 123.55,79 123.55,79.6 123.1,80.05 R10.1 115.06,80.05 F27.2 113.91,80 113.77,80.14 113.77,83.34 113.23,83.87 112.17,83.87 111.81,84.23 111.81,84.67 R63.P$1
  Bottom 0.406: R62.P$1 108.55,88.01 R63.P$1
N$9
  Top 0.178: Q10.1 122.65,76.24 123.01,75.87 126.21,75.87 126.57,76.22 126.57,76.58 126.75,76.76 128.13,76.76 R12.1
N$10
  Top 0.178: 120.21,77.29 D3.A 119.99,77.17 | R60.P$2 111.51,81.15
  Top 0.406: R60.P$2 111.15,81.15 R61.P$2 | Q10.2 124.55,77.54 124.26,77.83 121.77,77.83 121.23,77.29 120.21,77.29 | 111.51,81.15 114.3,78.36 119.63,78.36 119.99,78 119.99,77.17
N$11
  Top 0.178: 118.17,76.58 R13.2
  Top 0.406: D3.C 120.04,75.82 119.81,76.05 119.1,76.05 118.92,76.22 118.92,76.4 118.75,76.58 118.17,76.58
N$12  (via drill 0.5)
  Top 0.178: 123.79,73.56 Q9.3 123.97,73.74
  Top 0.406: R11.1 126.92,74.12 | 126.92,74.12 125.17,74.12 124.79,73.74 123.97,73.74 | v126.92,75.34 126.92,74.12 | F28.2 132.79,81.38 v132.97,81.2 | R61.P$1 113.08,77.85 114.53,76.4 116.43,76.4 116.97,75.87 116.97,75.11 117.12,74.95 117.77,74.95 R13.1 118.01,74.22 118.57,73.66 123.81,73.66 Q9.3
  Bottom 0.406: R60.P$1 108.3,81.15 R61.P$1 | v132.97,81.2 132.97,75.69 132.61,75.34 v126.92,75.34
N$13
  Top 0.178: Q9.1 122.9,70.82 123.19,70.54 126.75,70.54 126.92,70.71 126.92,71.42 127.1,71.6 R15.1
N$14
  Top 0.178: 124.79,71.53 Q9.2 | 120.55,72.34 120.55,72.49 | 111.73,74.62 R58.P$2
  Top 0.406: R58.P$2 111.66,72.77 R59.P$2 | D4.A 120.55,72.34 120.88,72.67 124.61,72.67 124.79,72.49 124.79,71.53 | 111.73,74.62 116.36,74.62 118.49,72.49 120.55,72.49
N$15
  Top 0.178: 120.43,69.56 D4.C
  Top 0.406: R16.2 120.43,69.56
N$16
  Top 0.178: 123.77,67.86 Q8.3 | 128,69.29 R14.1
  Top 0.406: 128,69.29 124.08,69.29 123.85,69.06 Q8.3 123.83,68.1 122.91,68.1 122.67,67.86 R16.1 116.13,67.86 F29.2 113.29,68.8 R59.P$1
  Bottom 0.406: R58.P$1 107.91,74.17 R59.P$1
N$17
  Top 0.178: Q8.1 122.9,65.44 123.22,65.13 125.65,65.15 125.88,65.38 125.88,66.42 126.34,66.88 128.03,66.88 R18.1
N$18
  Top 0.178: 120.58,65.91 D5.A